# Altium schematic sheet ГРЛМ.468332.031Э3 (Лист 3).SchDoc
size 420 x 297 mm; CheckedBy: Солдатов А.Ю.; Author: Соколов А.Р.; Organization: Формат А3; Address1: Схема электрическая; Address2: принципиальная; Address3: 123456; Address4: ЯДИМ.ХХХХХХ.ХХХЭ3; DocumentNumber: ГРЛМ.468332.031Э3; Revision: 0; SheetNumber: 3; SheetTotal: 2; PageSetup: Record=PageOptions|CenterHorizontal=True|CenterVertical=True|PrintScale=0.66|XCorrection=0.00|YCorrection=0.00|PrintKind=1|BorderSize=5000000|LeftOffset=0|BottomOffset=0|Orientation=2|PaperLength=4200|PaperWidth=2970|Scale=100|PaperSource=7|PrintQuality=-3|MediaType=1|DitherType=10|PrintScaleMode=0|PaperKind=A3|PaperIndex=8; ListStatus: Нов.; FileName: ГРЛМ.468332.031Э3.pdf; ProjectName: Плата
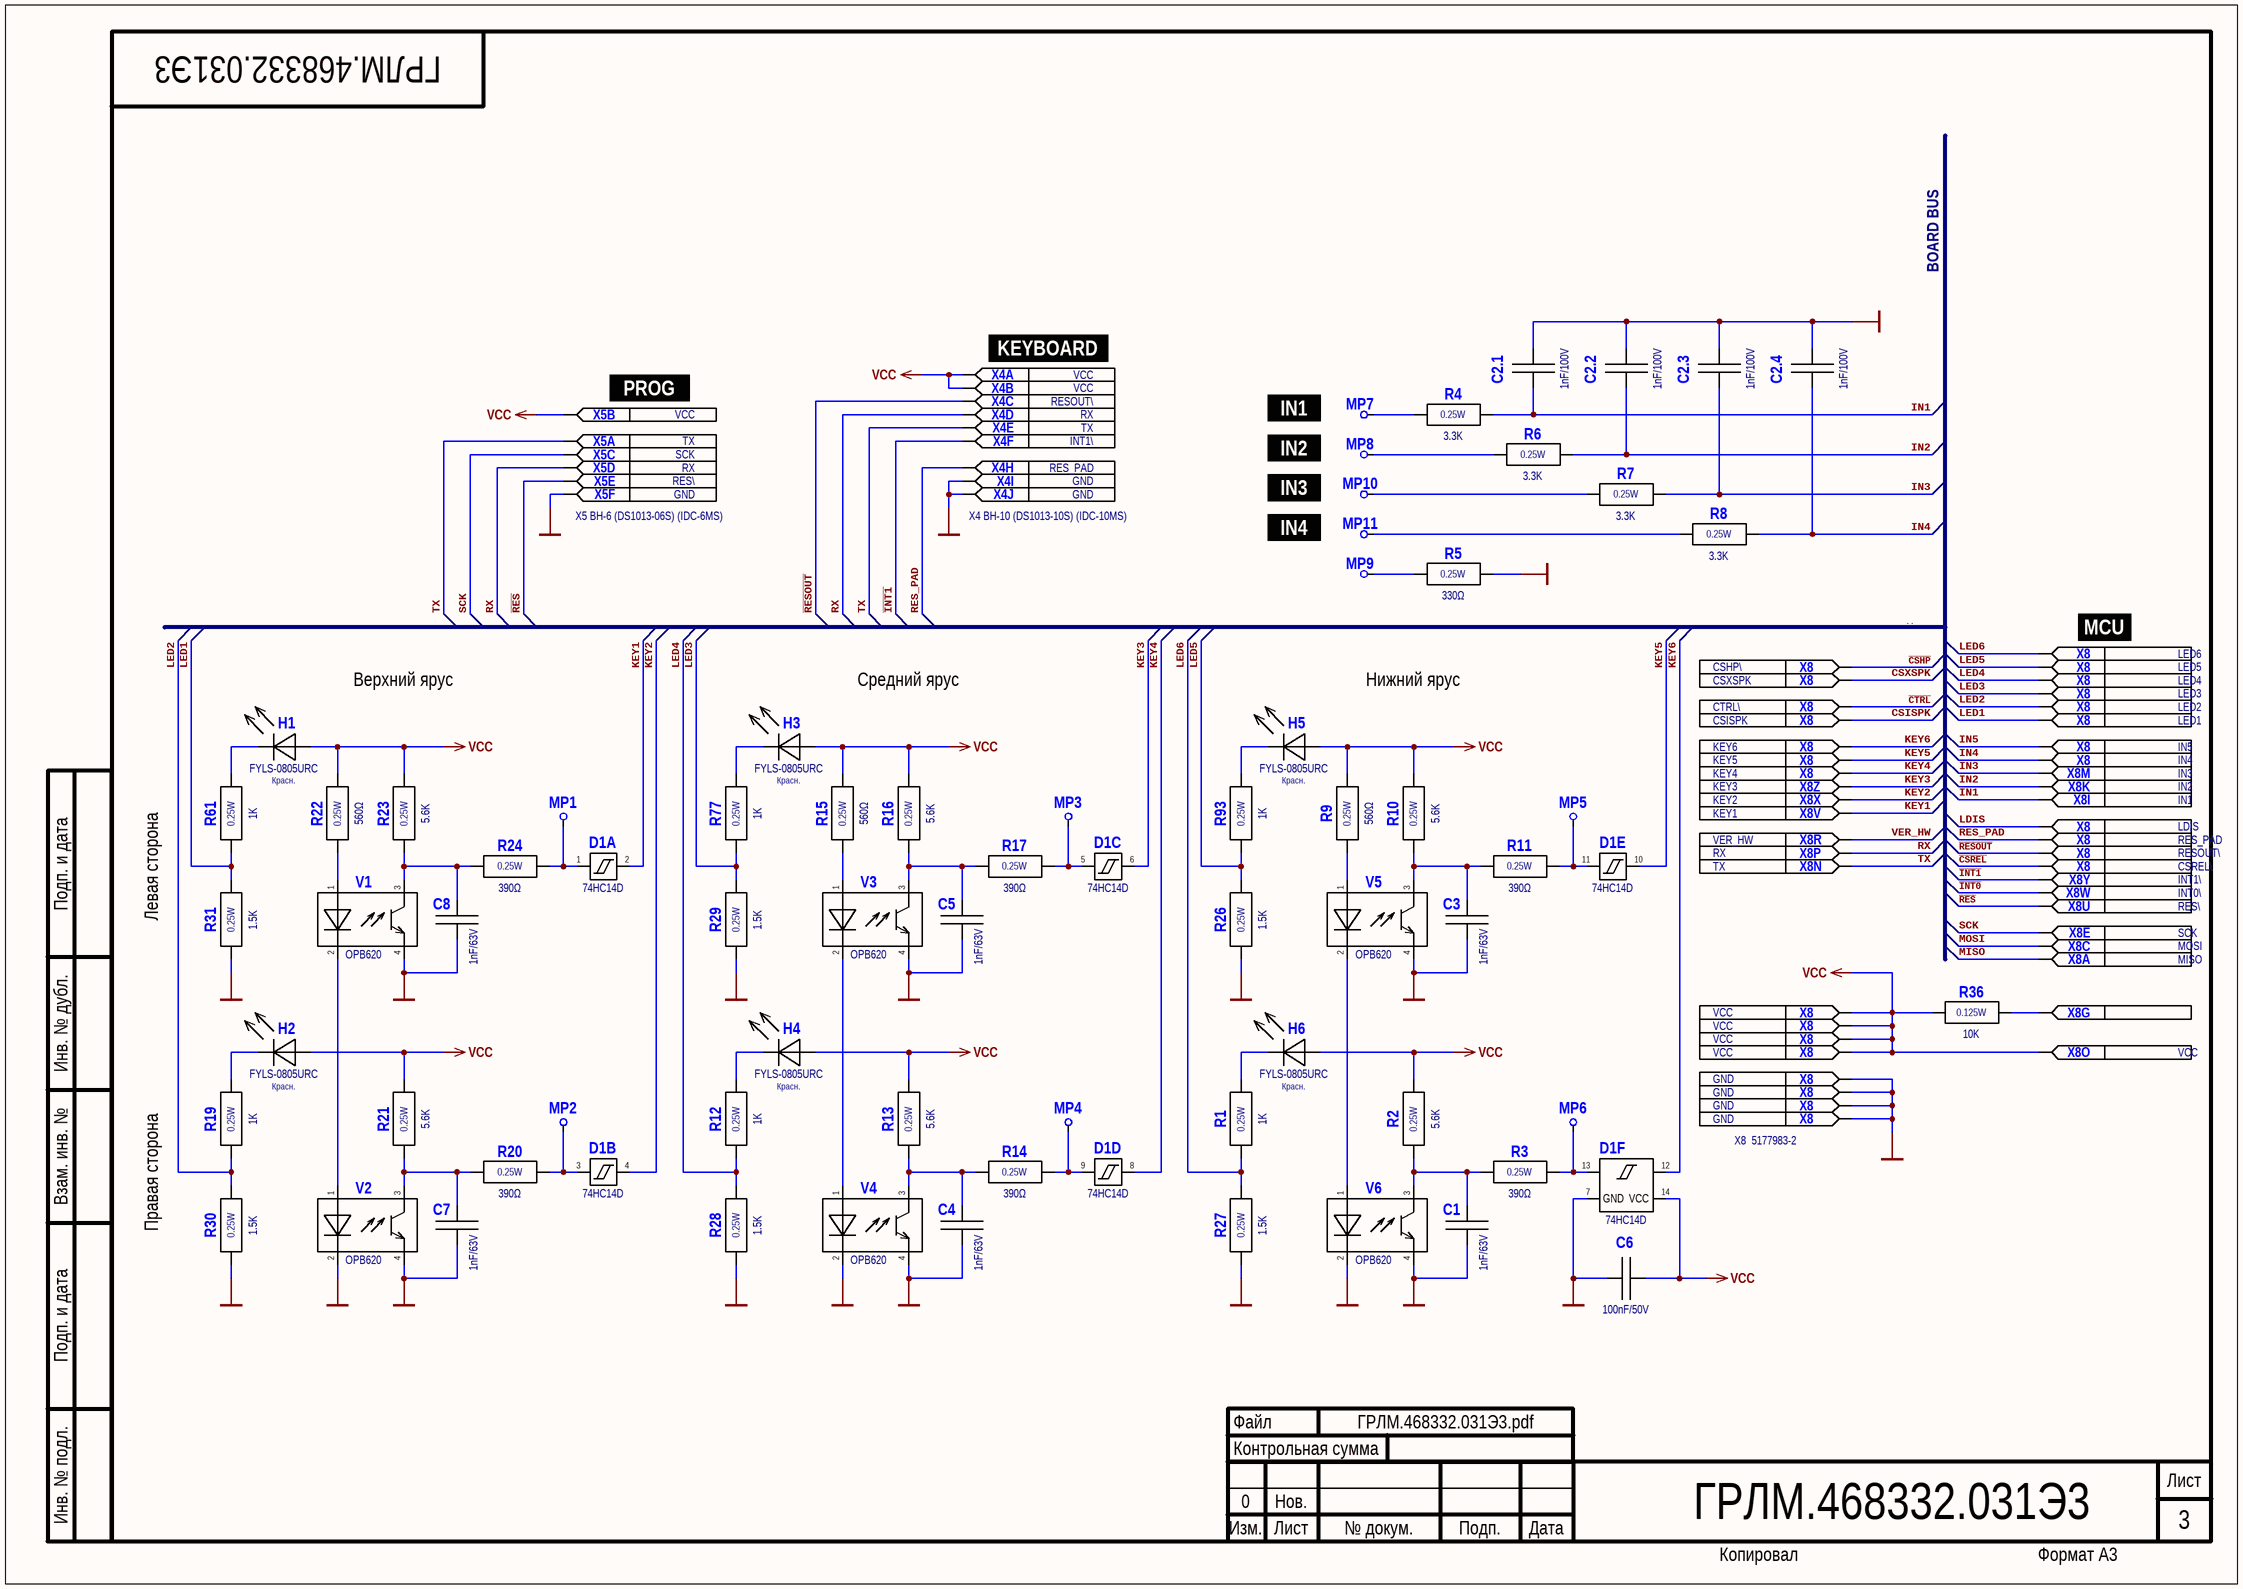
[diagram p0: ГРЛМ.468332.031Э3 (Лист 3).SchDoc]

## Parts
(Parts that share a designator on the sheet are numbered #1, #2 ... from top to bottom, then left to right.)
?#1  (no value)  (graphical)
?#2  (no value)  (graphical)
?#3  (no value)  (graphical)
C1  1nF/63V  [SMD Capacitor 0805]
C2.1  1nF/100V  [SMD Capacitor 0805]
C2.2  1nF/100V  [SMD Capacitor 0805]
C2.3  1nF/100V  [SMD Capacitor 0805]
C2.4  1nF/100V  [SMD Capacitor 0805]
C3  1nF/63V  [SMD Capacitor 0805]
C4  1nF/63V  [SMD Capacitor 0805]
C5  1nF/63V  [SMD Capacitor 0805]
C6  100nF/50V  [SMD Capacitor 0805]
C7  1nF/63V  [SMD Capacitor 0805]
C8  1nF/63V  [SMD Capacitor 0805]
D1  74HC14D  [SO14]  (parts A,B,C,D,E,F of 6)
H1  FYLS-0805URC  [LED SMD FYLS-0805URC]
H2  FYLS-0805URC  [LED SMD FYLS-0805URC]
H3  FYLS-0805URC  [LED SMD FYLS-0805URC]
H4  FYLS-0805URC  [LED SMD FYLS-0805URC]
H5  FYLS-0805URC  [LED SMD FYLS-0805URC]
H6  FYLS-0805URC  [LED SMD FYLS-0805URC]
MP1  TestPoint SMD  [Test point SMD]  (value not drawn)
MP2  TestPoint SMD  [Test point SMD]  (value not drawn)
MP3  TestPoint SMD  [Test point SMD]  (value not drawn)
MP4  TestPoint SMD  [Test point SMD]  (value not drawn)
MP5  TestPoint SMD  [Test point SMD]  (value not drawn)
MP6  TestPoint SMD  [Test point SMD]  (value not drawn)
MP7  TestPoint SMD  [Test point SMD]  (value not drawn)
MP8  TestPoint SMD  [Test point SMD]  (value not drawn)
MP9  TestPoint SMD  [Test point SMD]  (value not drawn)
MP10  TestPoint SMD  [Test point SMD]  (value not drawn)
MP11  TestPoint SMD  [Test point SMD]  (value not drawn)
R1  1K  Power dissipation: 0.25W  [SMD Resistor 1206]
R2  5.6K  Power dissipation: 0.25W  [SMD Resistor 1206]
R3  390Ω  Power dissipation: 0.25W  [SMD Resistor 1206]
R4  3.3K  Power dissipation: 0.25W  [SMD Resistor 1206]
R5  330Ω  Power dissipation: 0.25W  [SMD Resistor 1206]
R6  3.3K  Power dissipation: 0.25W  [SMD Resistor 1206]
R7  3.3K  Power dissipation: 0.25W  [SMD Resistor 1206]
R8  3.3K  Power dissipation: 0.25W  [SMD Resistor 1206]
R9  560Ω  Power dissipation: 0.25W  [SMD Resistor 1206]
R10  5.6K  Power dissipation: 0.25W  [SMD Resistor 1206]
R11  390Ω  Power dissipation: 0.25W  [SMD Resistor 1206]
R12  1K  Power dissipation: 0.25W  [SMD Resistor 1206]
R13  5.6K  Power dissipation: 0.25W  [SMD Resistor 1206]
R14  390Ω  Power dissipation: 0.25W  [SMD Resistor 1206]
R15  560Ω  Power dissipation: 0.25W  [SMD Resistor 1206]
R16  5.6K  Power dissipation: 0.25W  [SMD Resistor 1206]
R17  390Ω  Power dissipation: 0.25W  [SMD Resistor 1206]
R19  1K  Power dissipation: 0.25W  [SMD Resistor 1206]
R20  390Ω  Power dissipation: 0.25W  [SMD Resistor 1206]
R21  5.6K  Power dissipation: 0.25W  [SMD Resistor 1206]
R22  560Ω  Power dissipation: 0.25W  [SMD Resistor 1206]
R23  5.6K  Power dissipation: 0.25W  [SMD Resistor 1206]
R24  390Ω  Power dissipation: 0.25W  [SMD Resistor 1206]
R26  1.5K  Power dissipation: 0.25W  [SMD Resistor 1206]
R27  1.5K  Power dissipation: 0.25W  [SMD Resistor 1206]
R28  1.5K  Power dissipation: 0.25W  [SMD Resistor 1206]
R29  1.5K  Power dissipation: 0.25W  [SMD Resistor 1206]
R30  1.5K  Power dissipation: 0.25W  [SMD Resistor 1206]
R31  1.5K  Power dissipation: 0.25W  [SMD Resistor 1206]
R36  10K  Power dissipation: 0.125W  [SMD Resistor 0805]
R61  1K  Power dissipation: 0.25W  [SMD Resistor 1206]
R77  1K  Power dissipation: 0.25W  [SMD Resistor 1206]
R93  1K  Power dissipation: 0.25W  [SMD Resistor 1206]
V1  OPB620  [OPB620 Optocoupler]
V2  OPB620  [OPB620 Optocoupler]
V3  OPB620  [OPB620 Optocoupler]
V4  OPB620  [OPB620 Optocoupler]
V5  OPB620  [OPB620 Optocoupler]
V6  OPB620  [OPB620 Optocoupler]
X4  BH-10  [BH-10]  (value not drawn)  (parts A,B,C,D,E,F,H,I,J of 10)
X5  BH-6 (DS1013-06S) (IDC-6MS)  [BH-6]  (value not drawn)  (parts A,B,C,D,E,F of 6)
X8  5177983-2  [Connector 5177983-2]  (value not drawn)  (parts A,C,E,G,I,K,M,N,O,P,R,U,V,W,X,Y,Z,27,28,30,31,32,34,35,36,37,38,40,42,43,44,45,46,47,48,49,50,51,52,53,54,56,57,59 of 60)

## Nets
DGND: C1.1 C2.1.2 C2.2.2 C2.3.2 C2.4.2 C3.1 C4.1 C5.1 C6.1 C7.1 C8.1 D1.7(GND) R5.2 R26.1 R27.1 R28.1 R29.1 R30.1 R31.1 V1.4(Emitter) V2.2(Cathode) V2.4(Emitter) V3.4(Emitter) V4.2(Cathode) V4.4(Emitter) V5.4(Emitter) V6.2(Cathode) V6.4(Emitter) X4.9 X4.10 X5.6 X8.34 X8.36 X8.38 X8.50
VCC: C6.2 D1.14(VCC) H1.1 H2.1 H3.1 H4.1 H5.1 H6.1 R2.2 R9.2 R10.2 R13.2 R15.2 R16.2 R21.2 R22.2 R23.2 R36.1 X4.1 X4.2 X5.2 X8.15 X8.40 X8.42 X8.44 X8.52
~{CSHP}: X8.56
~{CSREL}: X8.27
~{CTRL}: X8.48
CSISPK: X8.46
CSXSPK: X8.54
~{INT0}: X8.23
~{INT1}: X4.6 X8.25
IN1: C2.1.1 R4.2 X8.9
IN2: C2.2.1 R6.2 X8.11
IN3: C2.3.1 R7.2 X8.13
IN4: C2.4.1 R8.2 X8.35
IN5: X8.37
KEY1: D1.2 X8.22
KEY2: D1.4 X8.24
KEY3: D1.6 X8.26
KEY4: D1.8 X8.28
KEY5: D1.10 X8.30
KEY6: D1.12 X8.32
LDIS: X8.45
LED1: R31.2 R61.1 X8.47
LED2: R19.1 R30.2 X8.49
LED3: R29.2 R77.1 X8.51
LED4: R12.1 R28.2 X8.53
LED5: R26.2 R93.1 X8.59
LED6: R1.1 R27.2 X8.57
MISO: X8.1
MOSI: X8.3
~{RES}: X5.5 X8.21
~{RESOUT}: X4.3 X8.31
RES_PAD: X4.8 X8.43
RX: X4.4 X5.4 X8.16
SCK: X5.3 X8.5
TX: X4.5 X5.1 X8.14
VER_HW: X8.18
NetC1_2: C1.2 R2.1 R3.1 V6.3(Collector)
NetC3_2: C3.2 R10.1 R11.1 V5.3(Collector)
NetC4_2: C4.2 R13.1 R14.1 V4.3(Collector)
NetC5_2: C5.2 R16.1 R17.1 V3.3(Collector)
NetC7_2: C7.2 R20.1 R21.1 V2.3(Collector)
NetC8_2: C8.2 R23.1 R24.1 V1.3(Collector)
NetD1_1: D1.1 MP1.1 R24.2
NetD1_3: D1.3 MP2.1 R20.2
NetD1_5: D1.5 MP3.1 R17.2
NetD1_9: D1.9 MP4.1 R14.2
NetD1_11: D1.11 MP5.1 R11.2
NetD1_13: D1.13 MP6.1 R3.2
NetH1_2: H1.2 R61.2
NetH2_2: H2.2 R19.2
NetH3_2: H3.2 R77.2
NetH4_2: H4.2 R12.2
NetH5_2: H5.2 R93.2
NetH6_2: H6.2 R1.2
NetMP7_1: MP7.1 R4.1
NetMP8_1: MP8.1 R6.1
NetMP9_1: MP9.1 R5.1
NetMP10_1: MP10.1 R7.1
NetMP11_1: MP11.1 R8.1
NetR9_1: R9.1 V5.1(Anode)
NetR15_1: R15.1 V3.1(Anode)
NetR22_1: R22.1 V1.1(Anode)
NetR36_2: R36.2 X8.7
NetV1_2: V1.2(Cathode) V2.1(Anode)
NetV3_2: V3.2(Cathode) V4.1(Anode)
NetV5_2: V5.2(Cathode) V6.1(Anode)

## Buses and harness runs
bus ..

## Notes on the sheet
- BOARD BUS
- (near X5) PROG
- (near X4) KEYBOARD
- VCC
- RESOUT\
- TX
- SCK
- RX
- INT1\
- RES_PAD
- IN1
- IN2
- (near X5) X5 BH-6 (DS1013-06S) (IDC-6MS)
- RES\
- GND
- (near X4) X4 BH-10 (DS1013-10S) (IDC-10MS)
- IN3
- IN4
- CSHP\
- (near X8) MCU
- LED6
- LED5
- Верхний ярус
- Средний ярус
- Нижний ярус
- CSISPK
- CTRL\
- CSXSPK
- LED1
- LED2
- LED3
- LED4
- Красн.
- KEY2
- KEY3
- KEY4
- KEY5
- KEY6
- IN5
- Левая сторона
- VER_HW
- KEY1
- CSREL\
- LDIS
- INT0\
- MISO
- MOSI
- (near X8) X8  5177983-2
- Правая сторона
- Подп. и дата
- Инв. № дубл.
- Взам. инв. №
- Инв. № подл.
- Файл
- Контрольная сумма
- Лист
- Изм.
- № докум.
- Подп.
- Дата
- Копировал
- Формат А3

## Library data of the parts
?#1 = Штамп с развернутым обозначением документа
?#2 = Левый нижний угловой штамп
?#3 = Основная напись второго и последующих листов
C1 C3-C5 C7 C8 = Capacitor: Partnumber: CC0805JRNPO0BN102; Vendor: Yageo; Type: Конденсатор керамический 1нФ 5% 100В COG SMD 0805
C2.1-C2.4 = Capacitor: Partnumber: AC0805JRNPO0BN102; Vendor: Yageo; Type: Конденсатор керамический 1 нФ 10% 100В SMD 0805
C6 = Capacitor: Partnumber: CC0805KRX7R9BB104; Vendor: Yageo; Type: Конденсатор керамический 100 нФ 5% 50В SMD 0805
D1 = 74HC14D: Hex inverting Schmitt trigger; Vendor: Philips Semiconductors; Type: Шесть инверторов с триггером Шмитта (5V логика); ComponentLink1URL: *; ComponentLink1URL: \STM32F429.pdf; Package: SOIC14; Partnumber: 74HC14D
H1-H6 = Diode_LED: Vendor: Foryard; Partnumber: FYLS-0805URC; Type: Светодиод красный SMD
MP1-MP11 = TestPoint SMD: SMD Test Point
R1 R12 R19 R61 R77 R93 = Resistor: Partnumber: RC1206JR-071KL; Vendor: Yageo; Type: Резистор 1,0 кОм 5% 0,25Вт SMD 1206
R2 R10 R13 R16 R21 R23 = Resistor: Partnumber: RC1206JR-075K6L; Vendor: Yageo; Type: Резистор 5,6 кОм 5% 0,25Вт SMD 1206
R3 R11 R14 R17 R20 R24 = Resistor: Partnumber: RC1206JR-07390RL; Vendor: Yageo; Type: Резистор 390 Ом 5% 0,25Вт SMD 1206
R4 R6-R8 = Resistor: Partnumber: RC1206JR-073K3L; Vendor: Yageo; Type: Резистор 3,3 кОм 5% 0,25Вт SMD 1206
R5 = Resistor: Partnumber: RC1206JR-07330RL; Vendor: Yageo; Type: Резистор 330 Ом 5% 0,25Вт SMD 1206
R9 R15 R22 = Resistor: Partnumber: RC1206JR-07560RL; Vendor: Yageo; Type: Резистор 560 Ом 5% 0,25Вт SMD 1206
R26-R31 = Resistor: Partnumber: RC1206JR-071K5L; Vendor: Yageo; Type: Резистор 1,5 кОм 5% 0,25Вт SMD 1206
R36 = Resistor: Partnumber: RC0805JR-0710KL; Vendor: Yageo; Type: Резистор 10 кОм 5% 0,125Вт SMD 0805
V1-V6 = OPB620: Slotted Optical Switch 890 nm; Vendor: OPTEK Technology; Type: Щелевой оптрон; Partnumber: OPB620
X4 = Connector 10 pins (universal): Partnumber: BH-10 (DS1013-10S) (IDC-10MS); Vendor: Connfly; Type: Соединитель для подключения внешнего шлейфа с шагом 1.27мм
X5 = Connector 6 pins (universal): Vendor: Connfly; Type: Соединитель 6 контактов.; Partnumber: BH-6 (DS1013-06S) (IDC-6MS)
X8 = Connector 60 pins (universal): Vendor: TE; Type: Соединитель 60 полюсов; Partnumber: 5177983-2